# EasyEDA Pro project ProPrj_Avaota A1 八核 AIoT 开发板_2024-05-03.epro, board PCB1 (continued)
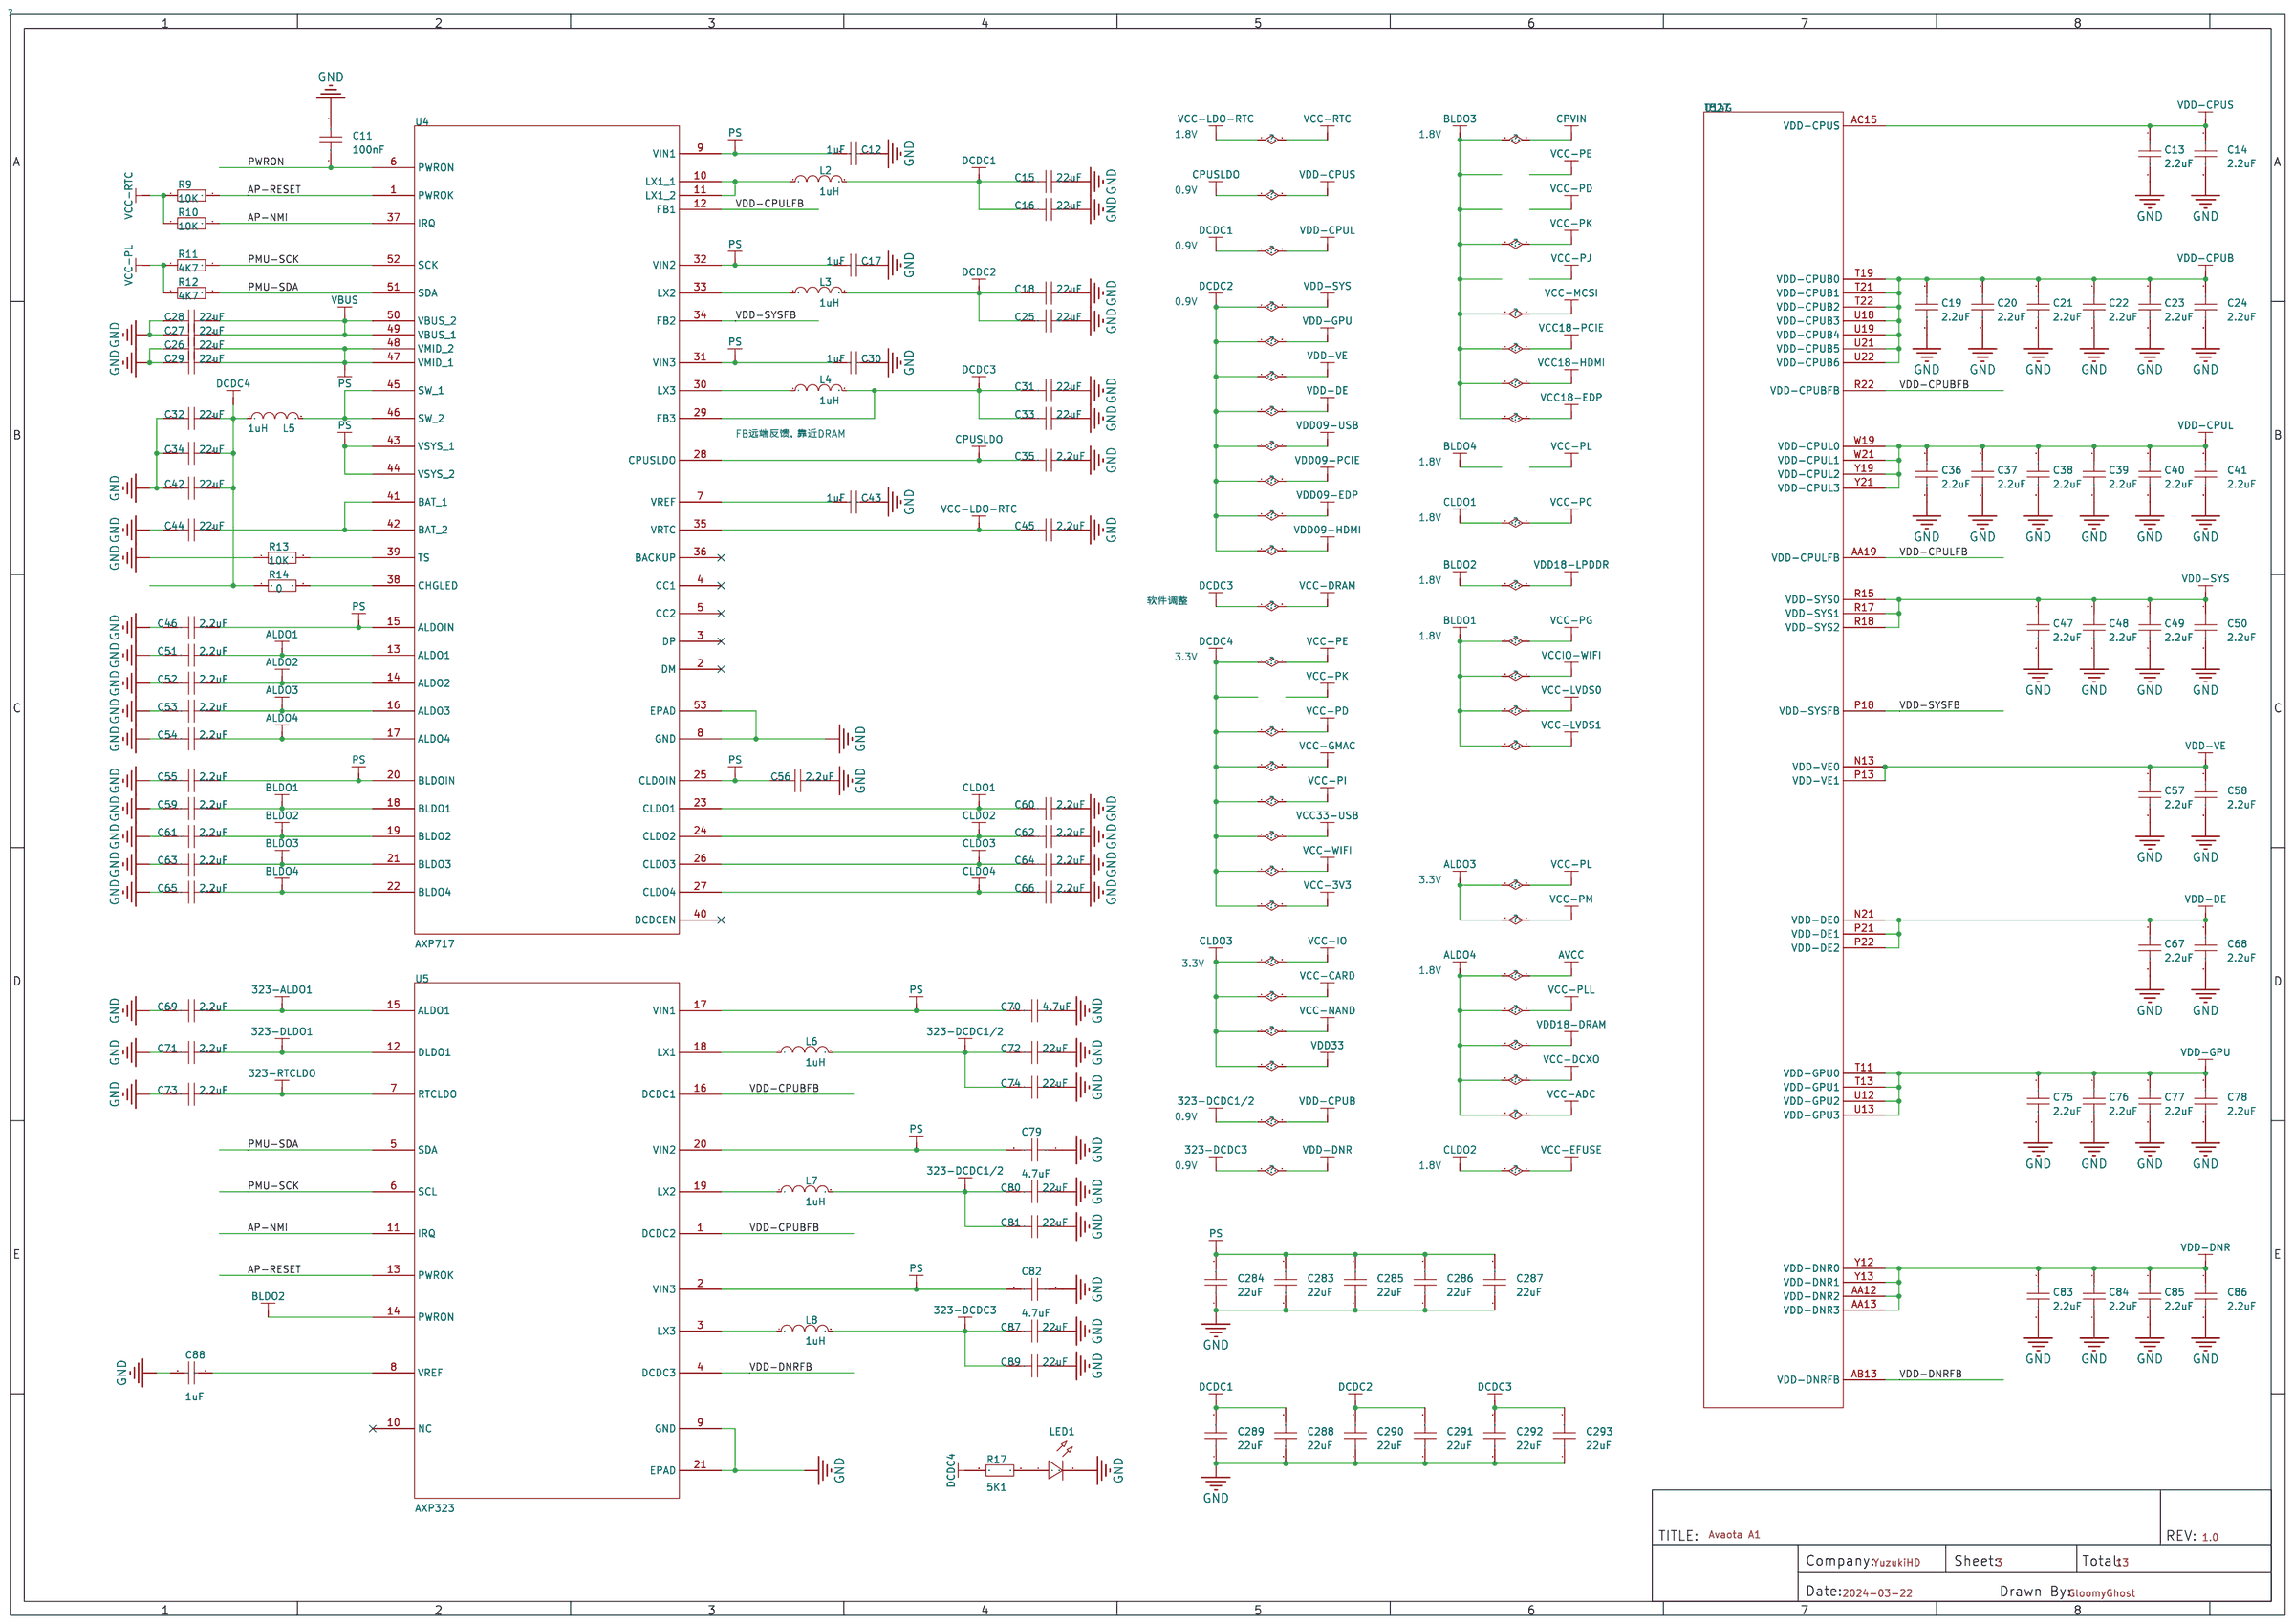
[diagram p0: POWER]
## Routing (per net, layer and track width the routed paths; a pad name or vN(x,y) marks a point on that pad's centre or on a via; arc(x,y) is an arc through that point) (continued)
  内层2 w0.102: v1(85.37,26.61) 85.37,27.15 85.5,27.28 85.5,48.18 84.81,48.87 84.81,52.3 83.92,53.19 83.92,54.13 83.41,54.64 v1(83.39,54.64)
RGMII1-RXD1: length 52.5
  Top Layer w0.076: 68.01,57.58 68.01,56.22 67.94,56.14
  Top Layer w0.102: v1(83.92,54.69) 83.72,54.89 83.72,57.2 81.41,59.51 69.89,59.51 68.01,57.64 68.01,57.58
  Top Layer w0.152: v1(85.95,26.61) 85.95,26.39 85.36,25.79 85.36,24.79
  内层2 w0.102: v1(83.92,54.69) 84.25,54.36 84.25,53.39 85.14,52.5 85.14,49.1 85.83,48.41 85.83,27.31 85.95,27.18 v1(85.95,26.61)
RGMII1-RXD2: length 60.4
  Top Layer w0.102: v1(65.95,54.65) U14.J4
  Top Layer w0.152: v1(86.51,26.61) 86.51,26.54 85.76,25.79 85.76,24.79
  内层2 w0.102: v1(65.95,54.65) 66.8,53.8 67.11,53.8 67.31,54 67.31,55.7 67.21,55.8 67.21,59.03 68.33,60.15 82.32,60.15 84.66,57.81 84.66,53.49 85.47,52.68 85.47,49.25 86.13,48.59 86.13,27.48 86.51,27.1 v1(86.51,26.61)
RGMII1-RXD3: length 59.7
  Top Layer w0.102: U14.G5 v1(66.95,54.65)
  Top Layer w0.152: 86.16,24.79 86.16,25.63 87.07,26.54 v1(87.07,26.61)
  内层2 w0.102: v1(87.07,26.61) 87.07,27.05 86.46,27.66 86.46,48.84 85.85,49.45 85.85,52.86 85.04,53.67 85.04,57.96 82.47,60.53 68.17,60.53 66.9,59.26 66.9,55.65 66.57,55.32 66.57,55.03 v1(66.95,54.65)
RGMII1-TXCK: length 60.4
  Top Layer w0.076: 66.44,56.14 66.44,56.25 66.6,56.41 66.6,58.15 66.77,58.32 66.77,58.46
  Top Layer w0.102: 87.26,24.09 87.59,24.09 87.76,24.26 v1(87.76,25.1) ; 66.77,58.46 66.77,59 69.03,61.27 83.03,61.27 86.94,57.35 86.94,53.95 v1(86.18,53.19)
  内层2 w0.102: v1(86.18,53.19) 86.23,53.14 86.23,49.58 86.82,49 86.82,27.91 87.5,27.23 87.5,25.35 v1(87.76,25.1)
RGMII1-TXCTL: length 60.4
  Top Layer w0.076: 66.44,55.64 66.69,55.89 66.69,56.23 66.78,56.32 66.78,58.04 67.03,58.29 67.03,58.52
  Top Layer w0.102: v1(86.51,54.15) 86.47,54.15 86.59,54.27 86.59,57.12 82.75,60.96 69.21,60.96 67.03,58.78 67.03,58.52 ; U13.19 87.72,23.69 88.32,24.28 v1(88.32,25.1)
  内层2 w0.102: v1(88.32,25.1) 87.83,25.58 87.83,27.38 87.15,28.07 87.15,49.25 86.61,49.78 86.61,53.42 86.51,53.52 v1(86.51,54.15)
RGMII1-TXD0: length 59.9
  Top Layer w0.076: 67.53,58.36 67.53,58.08 67.24,57.78 67.24,56.57 67.19,56.52 67.19,55.89 66.94,55.64
  Top Layer w0.102: 87.26,23.29 87.86,23.29 88.87,24.31 v1(88.87,25.1) ; 67.52,58.34 69.58,60.4 82.17,60.4 84.81,57.76 84.81,55.88 85.39,55.3 v1(85.42,55.3)
  内层2 w0.102: v1(85.42,55.3) 85.72,54.99 86.56,54.99 86.97,54.58 86.97,49.96 87.5,49.43 87.5,28.22 88.16,27.56 88.16,25.81 v1(88.87,25.1)
RGMII1-TXD1: length 61.1
  Top Layer w0.076: 66.94,56.14 67.01,56.22 67.01,57.94 67.28,58.21 67.28,58.56 67.3,58.57
  Top Layer w0.102: U13.17 88.01,22.89 89.46,24.34 v1(89.46,25.1) ; v1(86.13,55.52) 85.93,55.73 85.55,55.73 85.19,56.08 85.19,57.94 82.45,60.68 69.4,60.68 67.3,58.57
  内层2 w0.102: v1(89.46,25.1) 88.52,26.04 88.52,27.71 87.86,28.37 87.86,49.66 87.33,50.19 87.33,54.71 86.77,55.27 86.39,55.27 v1(86.13,55.52)
RGMII1-TXD2: length 66.4
  Top Layer w0.102: v1(90.02,25.1) 90.02,24.38 88.12,22.49 U13.16 ; v1(64.95,54.15) U14.L5
  内层2 w0.102: v1(64.95,54.15) 65.33,54.52 65.33,56.85 65.81,57.33 65.81,58.73 68.07,60.99 82.6,60.99 86.54,57.05 86.54,56.03 87.68,54.89 87.68,50.39 88.19,49.89 88.19,28.58 88.9,27.86 88.9,26.21 v1(90.02,25.1)
RGMII1-TXD3: length 68.1
  Top Layer w0.102: U14.L4 v1(64.95,54.65) ; 87.26,22.09 87.82,22.09 87.86,22.05 88.21,22.05 v1(89.31,23.14)
  内层2 w0.102: v1(89.31,23.14) 89.31,23.55 89.89,24.13 90.22,24.13 90.75,24.66 90.75,24.97 89.31,26.42 89.31,27.99 88.54,28.75 88.54,50.17 88.01,50.7 88.01,55.12 86.89,56.24 86.89,57.23 82.8,61.32 67.92,61.32 65.46,58.85 65.46,57.43 64.95,56.92 v1(64.95,54.65)
SAA0: length 16.5
  Top Layer w0.076: 55.43,40.14 55.18,40.39 55.18,40.75 54.87,41.07 v3(54.87,41.12)
  Top Layer w0.115: 41.41,44.85 41.71,45.16 42.34,45.16 42.47,45.03 43.33,45.03 44.27,44.09 44.42,44.09 v3(44.78,43.74)
  Inner5 w0.115: v3(54.87,41.12) 54.79,41.05 52.42,41.05 51.43,42.04 47.27,42.04 46.48,42.82 46.2,42.82 45.28,43.74 v3(44.78,43.74)
SAA1: length 17.3
  Top Layer w0.076: 55.43,40.64 55.43,40.75 55.19,40.99 55.19,41.42 v3(54.96,41.66)
  Top Layer w0.115: v3(44.4,44.48) 44.4,44.81 43.33,45.87 42.97,45.87 42.76,45.65 42.58,45.65 42.44,45.8 42.06,45.8 41.76,45.5 41.41,45.5
  Inner5 w0.076: 54.18,41.33 54.51,41.33 54.61,41.35 v3(54.96,41.66)
  Inner5 w0.115: 54.18,41.33 53.17,41.33 52.3,42.19 51.67,42.19 51.42,42.44 47.38,42.44 46.63,43.19 46.35,43.19 45.22,44.32 44.56,44.32 44.41,44.48 v3(44.4,44.48) ; v3(54.96,41.66) 54.92,41.66
SAA2: length 23.6
  Top Layer w0.102: v3(36.17,45.18) 36.16,45.18 35.83,44.85 35.81,44.85
  Top Layer w0.115: 56.43,41.64 56.43,41.68 v3(55.98,42.14)
  Inner5 w0.076: 54.05,41.93 54.13,42.01 55.09,42.01 55.29,41.81 55.6,41.81 55.93,42.14 v3(55.98,42.14)
  Inner5 w0.115: v3(36.17,45.18) 36.24,45.11 37.62,45.11 38.12,45.62 38.63,45.62 39.01,45.24 39.01,45.02 39.13,44.91 40.51,44.91 40.68,44.74 43.56,44.74 44.08,45.26 44.66,45.26 44.88,45.05 45.54,45.05 46.66,43.93 46.94,43.93 47.66,43.21 51.61,43.21 52,42.82 52.27,42.82 52.35,42.9 52.91,42.9 53.87,41.93 54.05,41.93
SAA3: length 26.5
  Top Layer w0.115: 56.43,42.14 56.43,42.19 55.98,42.65 v3(55.98,42.67) ; v3(35.33,45.17) 35.01,44.85
  内层2 w0.076: 53.87,42.82 54.07,43.02 55.7,43.02 55.98,42.75 v3(55.98,42.67)
  内层2 w0.115: v3(35.33,45.17) 35.72,44.78 36.4,44.78 36.73,45.11 36.73,46.25 36.85,46.38 37.87,46.38 37.97,46.28 37.97,45.14 38.4,44.7 38.63,44.7 39.16,44.17 40.56,44.17 40.76,44.37 41.48,44.37 42.39,43.46 42.7,43.46 43.58,42.57 43.97,42.57 44.18,42.35 52.31,42.35 52.5,42.16 53.21,42.16 53.87,42.82
SAA4: length 24.9
  Top Layer w0.102: v3(34.59,45.26) 34.59,45.24 34.21,44.85
  Top Layer w0.115: v3(55.43,42.15) 55.43,41.64
  Inner5 w0.076: 53.99,42.19 55.4,42.19 v3(55.43,42.15)
  Inner5 w0.115: 53.99,42.19 52.94,43.23 52.6,43.23 52.25,43.59 47.8,43.59 47.09,44.3 46.81,44.3 45.69,45.41 45.03,45.42 44.82,45.63 43.93,45.63 43.41,45.11 41.83,45.11 41.68,45.26 40.13,45.26 39.57,45.82 39.19,45.82 38.89,46.13 38.89,46.25 38.76,46.38 36.04,46.38 35.89,46.23 35.1,46.23 34.59,45.72 v3(34.59,45.26)
SAA5: length 29.7
  Top Layer w0.115: 34.21,45.5 34.21,45.51 34.57,45.87 34.57,46.35 v3(34.72,46.51) ; v3(55.93,41.63) 55.92,41.63 55.43,41.14
  Inner5 w0.115: v3(34.72,46.51) 35.23,47.02 35.23,47.24 37.16,49.17 38.89,49.17 39.16,49.45 39.67,49.45 39.88,49.25 40.41,49.25 40.59,49.43 41.1,49.43 41.35,49.18 41.35,49 41.68,48.67 42.67,48.67 43.47,47.87 45.39,47.87 46.97,46.29 47.6,46.29 48.02,45.87 52.09,45.87 52.47,45.49 52.7,45.49 54.05,44.14 54.05,43.56 54.3,43.31 55.88,43.31 56.34,42.85 56.34,41.96 56,41.63 v3(55.93,41.63)
SAB0: length 23.2
  Top Layer w0.115: 55.47,44.1 55.43,44.14 55.47,44.1 ; 55.47,44.1 v3(55.47,43.68) ; 41.41,49.4 41.51,49.4 v3(41.81,49.1)
  内层2 w0.076: 54,43.21 55.12,43.21 55.47,43.56 v3(55.47,43.68)
  内层2 w0.115: v3(41.81,49.1) 42.19,48.72 42.19,47.37 44.93,44.63 45.22,44.63 46.25,43.6 46.25,42.99 46.57,42.67 46.72,42.67 46.83,42.79 46.83,43.27 46.95,43.38 47.1,43.38 47.21,43.27 47.21,42.79 47.33,42.67 47.48,42.67 47.59,42.79 47.59,43.27 47.71,43.38 47.86,43.38 47.97,43.27 47.97,42.79 48.09,42.67 48.77,42.67 48.89,42.79 48.89,42.92 49,43.04 49.15,43.04 49.27,42.92 49.27,42.79 49.38,42.67 49.53,42.67 49.65,42.79 49.65,42.92 49.76,43.04 49.92,43.04 50.03,42.92 50.03,42.79 50.14,42.67 50.3,42.67 50.41,42.79 50.41,42.92 50.53,43.04 50.68,43.04 50.79,42.92 50.79,42.79 50.91,42.67 51.06,42.67 51.17,42.79 51.17,42.92 51.29,43.04 51.44,43.04 51.55,42.92 51.55,42.79 51.67,42.67 52.42,42.67 52.83,43.08 53.47,43.08 53.59,43.21 54,43.21
SAB1: length 22.6
  Top Layer w0.115: v3(43.71,48.29) 43.7,48.29 43.36,48.29 43.02,48.62 42.5,48.62 42.31,48.44 42.06,48.44 41.86,48.64 41.51,48.64 41.41,48.75 ; 55.93,44.14 56.01,44.07 v3(56.01,43.68)
  内层2 w0.115: v3(56.01,43.68) 55.59,44.09 52.52,44.09 52.07,44.55 51.14,44.55 51.03,44.44 51.03,44.1 50.91,43.98 50.76,43.98 50.64,44.1 50.64,44.44 50.53,44.55 50.38,44.55 50.26,44.44 50.26,44.1 50.15,43.98 50,43.98 49.88,44.1 49.88,44.44 49.77,44.55 49.62,44.55 49.5,44.44 49.5,44.1 49.39,43.98 49.23,43.98 49.12,44.1 49.12,44.44 49.01,44.55 46.96,44.55 45.78,45.73 45.39,45.73 44.33,46.79 44.33,46.97 44.88,47.52 44.88,47.7 44.65,47.93 44.28,47.93 44.12,47.77 44.12,47.39 44,47.28 43.84,47.28 43.71,47.41 v3(43.71,48.29)
SAB2: length 23.2
  Top Layer w0.102: v3(36.19,49.78) 35.81,49.4
  Top Layer w0.115: v3(54.43,43.71) 54.43,44.14
  内层2 w0.115: v3(54.43,43.71) 54.36,43.79 52.45,43.79 52.26,43.98 51.47,43.98 51.2,43.71 49.05,43.71 48.66,44.09 46.9,44.09 45.63,45.36 45.24,45.36 43.33,47.27 43.33,48.68 42.15,49.86 40.46,49.86 40.36,49.96 39.24,49.96 38.71,49.43 36.54,49.43 v3(36.19,49.78)
SAB3: length 25.3
  Top Layer w0.115: v3(54.96,43.68) 54.96,44.11 54.93,44.14 ; v3(37.79,48.44) 37.16,49.07 35.33,49.07 35.01,49.4
  内层2 w0.076: 53.44,43.54 53.95,43.54 54.1,43.38 54.67,43.38 v3(54.96,43.68)
  内层2 w0.115: v3(37.79,48.44) 38.4,49.05 38.78,49.05 39.22,49.48 39.65,49.48 40,49.12 40.33,49.12 40.69,49.48 41.96,49.48 42.95,48.49 42.95,47.13 45.08,45 45.38,45 46.66,43.71 48.54,43.71 48.92,43.33 51.46,43.33 51.74,43.61 52.25,43.61 52.42,43.43 53.34,43.43 53.44,43.54
SAB4: length 26
  Top Layer w0.102: 34.21,49.4 34.21,49.21 34.52,48.89 34.52,48.67 34.75,48.44 35.13,48.44 35.43,48.14 35.43,47.37 35.63,47.17 v3(35.63,47.14)
  Top Layer w0.115: v3(55.47,42.7) 55.43,42.73 55.43,43.14
  Inner5 w0.076: v3(55.47,42.7) 55.14,42.37 54.15,42.37 54.07,42.44
  Inner5 w0.115: v3(35.63,47.14) 36.01,46.76 39.88,46.76 40.59,46.05 40.59,45.77 40.75,45.61 42.74,45.61 43.13,46 44.97,46 45.18,45.78 45.84,45.78 46.96,44.67 47.24,44.67 47.94,43.97 52.3,43.97 52.73,43.54 53.01,43.54 54.07,42.47 54.07,42.44
SAB5: length 27
  Top Layer w0.102: v3(34.34,46.96) 34.49,47.12 34.49,48.39 34.21,48.67 34.21,48.75
  Top Layer w0.115: 54.43,42.14 v3(54.43,41.66)
  Inner5 w0.115: v3(54.43,41.66) 53.17,41.66 52.35,42.48 51.9,42.48 51.56,42.82 47.52,42.82 46.79,43.56 46.5,43.56 45.39,44.68 44.72,44.68 44.52,44.88 44.25,44.88 43.69,44.32 40.66,44.32 40.5,44.16 39.17,44.16 38.63,44.7 38.28,44.7 37.89,44.32 36.55,44.32 36.17,44.7 35,44.7 34.85,44.86 34.41,44.86 34.19,45.08 34.19,46.81 v3(34.34,46.96)
SCKE0-A: length 22
  Top Layer w0.076: 52.95,40.58 53.26,40.89 53.54,40.89 53.79,41.14 53.93,41.14
  Top Layer w0.115: v3(45.75,42.76) 46.17,42.76 48.35,40.58 52.95,40.58 ; 39.81,45.5 39.81,45.73 39.69,45.85 38.66,45.85 v3(38.5,46)
  内层2 w0.115: v3(45.75,42.76) 45.75,43.28 44.92,44.11 44.25,44.11 43.38,44.98 42.72,44.98 42.16,45.54 42.16,46.66 41.43,47.4 39.27,47.4 38.5,46.63 v3(38.5,46)
SCKE0-B: length 21.4
  Top Layer w0.076: 52.49,43.14 52.25,42.9 51.79,42.9 51.66,43.03
  Top Layer w0.097: 53.43,43.14 52.49,43.14
  Top Layer w0.115: v3(45.11,47.12) 45.03,47.12 44.22,47.93 44.22,48.15 44.38,48.31 44.57,48.31 45.87,47.02 46.45,47.02 46.89,46.58 46.89,45.29 49.15,43.03 51.66,43.03 ; 39.81,48.75 39.7,48.75 v3(39.39,48.44)
  Inner5 w0.115: v3(45.11,47.12) 43.18,47.12 43.03,47.27 41.04,47.27 40.41,47.9 39.19,47.9 39.06,48.03 39.06,48.27 39.23,48.44 v3(39.39,48.44)
SCKE1-A: length 22.4
  Top Layer w0.076: 54.43,41.14 54.18,40.89 53.83,40.89 53.68,40.74 53.68,40.5 53.57,40.39 53.33,40.39 52.93,39.99
  Top Layer w0.102: v3(38.5,45.21) 38.78,45.49 38.98,45.49 38.99,45.5 39.01,45.5
  Top Layer w0.115: 52.93,39.99 52.86,39.99 52.85,39.98 48.11,39.98 46,42.09 45.38,42.09 45.02,42.44 45.02,42.89 44.71,43.19 44.31,43.19 v3(44.09,42.98)
  内层2 w0.115: v3(38.5,45.21) 38.76,45.21 39.04,44.93 39.6,44.93 39.77,45.11 39.77,46.13 40.03,46.38 40.41,46.38 40.61,46.18 40.61,45.29 40.92,44.98 41.43,44.98 42.16,44.25 43,44.25 43.23,44.02 43.23,43.46 43.7,42.99 44.09,42.99 v3(44.09,42.98)
SCKE1-B: length 21.8
  Top Layer w0.076: 53.93,43.14 53.68,42.89 53.22,42.89 53.14,42.97 52.57,42.97 52.32,42.72 51.55,42.72
  Top Layer w0.115: 39.01,48.75 38.97,48.75 v3(38.63,48.41) ; 51.55,42.72 51.52,42.7 49.1,42.7 46.62,45.18 46.62,46.4 46.33,46.68 45.87,46.68 v3(45.7,46.52)
  Inner5 w0.115: v3(45.7,46.52) 45.55,46.52 45.34,46.74 43.04,46.74 42.88,46.89 40.87,46.89 40.23,47.52 38.8,47.52 38.69,47.64 38.69,47.92 38.58,48.03 38.35,48.03 38.23,47.92 38.23,47.64 38.12,47.52 37.92,47.52 37.82,47.62 37.82,47.93 38.3,48.41 v3(38.63,48.41)
SCKN-A: length 21.6
  Top Layer w0.076: 35.81,45.5 36.02,45.5 36.1,45.58 36.1,46.41 36.08,46.43 36.08,46.45 ; 52.35,41.43 52.47,41.55 52.58,41.55 52.7,41.43 52.81,41.43 52.97,41.59 53.39,41.59 53.43,41.64
  Top Layer w0.127: 52.35,41.43 48.64,41.43 45.39,44.68 45.39,44.98 43.41,46.96 36.3,46.96 36.08,46.74 36.08,46.45
SCKN-B: length 21.2
  Top Layer w0.076: 53.43,42.14 53.33,42.14 53.2,42.01 52.48,42.01 52.35,42.14 51.97,42.14 51.69,41.86 50.74,41.86 50.71,41.88 50.54,41.88 ; 36.77,47.38 36.76,47.38 36.74,47.4 36.68,47.4 36.65,47.43 36.59,47.43 36.12,47.89 36.12,48.44 35.81,48.75
  Top Layer w0.127: 50.54,41.88 48.86,41.88 45.9,44.85 45.9,45.11 43.63,47.38 36.77,47.38
SCKP-A: length 21.6
  Top Layer w0.076: 36.61,45.5 36.31,45.8 36.31,46.41 36.33,46.43 36.33,46.45 ; 52.35,41.17 52.85,41.17 53.07,41.39 53.68,41.39 53.93,41.64
  Top Layer w0.127: 52.35,41.17 48.54,41.17 45.13,44.58 45.13,44.88 43.31,46.71 36.41,46.71 36.33,46.63 36.33,46.45
SCKP-B: length 21.9
  Top Layer w0.076: 50.54,42.14 50.75,42.14 50.82,42.06 51.04,42.06 51.11,42.14 51.11,42.21 51.19,42.29 51.34,42.29 51.42,42.21 51.42,42.14 51.5,42.06 51.6,42.06 51.87,42.33 52.39,42.33 52.39,42.33 52.41,42.33 52.53,42.2 53.07,42.2 53.26,42.39 53.68,42.39 53.93,42.64 ; 36.77,47.63 36.67,47.63 36.3,48 36.3,48.67 36.37,48.75 36.61,48.75
  Top Layer w0.127: 36.77,47.63 43.73,47.63 46.15,45.21 46.15,44.96 48.97,42.14 50.54,42.14
SCS0-A: length 21
  Top Layer w0.076: 53.43,40.64 53.29,40.64 52.93,40.28 52.78,40.28
  Top Layer w0.115: v3(45.24,43.23) 45.39,43.08 45.39,42.6 45.59,42.39 46.12,42.39 48.23,40.28 52.78,40.28 ; 39.81,44.85 39.76,44.85 39.39,45.21 v3(39.39,45.29)
  内层2 w0.115: v3(45.24,43.23) 45.11,43.36 43.85,43.36 43.6,43.61 43.6,44.17 43.15,44.61 42.43,44.61 41.37,45.67 41.37,46.9 41.26,47.02 39.39,47.02 39.01,46.63 39.01,45.67 v3(39.39,45.29)
SCS0-B: length 23.7
  Top Layer w0.115: v3(39.39,49.1) 39.69,49.4 39.81,49.4 ; 54.93,42.14 54.93,42.17 v3(54.41,42.7)
  Inner5 w0.115: v3(39.39,49.1) 39.11,48.82 37.62,48.82 37.41,48.62 37.41,47.35 37.62,47.14 40.03,47.14 40.7,46.47 42.79,46.47 42.88,46.37 45.12,46.37 45.34,46.15 46,46.15 47.11,45.03 47.4,45.03 48.12,44.31 52.36,44.31 52.78,43.89 53.03,43.89 54.23,42.7 v3(54.41,42.7)
SCS1-A: length 20.7
  Top Layer w0.076: 52.86,38.63 53,38.78 53,39.16 53.68,39.84 53.68,40.25 53.93,40.49 53.93,40.64
  Top Layer w0.115: 52.86,38.63 52.47,38.63 52.27,38.84 52.27,39.4 51.99,39.67 47.9,39.67 45.84,41.73 45.21,41.73 44.65,42.29 44.65,42.72 v3(44.63,42.75) ; 40.61,44.85 40.88,44.85 40.99,44.73 40.99,43.94 v3(41.02,43.92)
  Inner5 w0.115: v3(44.63,42.75) 44.74,42.75 44.85,42.86 44.85,43.24 44.74,43.36 43.9,43.36 43.79,43.47 43.79,43.85 43.67,43.97 43.44,43.97 43.33,43.85 43.33,43.36 43.22,43.24 42.94,43.24 42.72,43.46 42.56,43.46 42.44,43.57 42.44,43.84 42.36,43.92 42.11,43.92 42,43.8 42,43.7 41.88,43.59 41.66,43.59 41.54,43.7 41.54,43.8 41.43,43.92 v3(41.02,43.92)
SCS1-B: length 22.5
  Top Layer w0.102: 54.93,43.14 54.93,42.7 v3(54.94,42.7)
  Top Layer w0.115: v3(40.92,49.07) 40.92,49.09 40.61,49.4
  Inner5 w0.115: v3(54.94,42.7) 55.02,42.7 55.12,42.79 55.12,42.95 55.01,43.05 54.25,43.05 53.72,43.59 53.72,43.93 53.61,44.04 53.39,44.04 53.29,44.14 53.29,44.27 53.16,44.4 52.73,44.4 52.53,44.6 52.53,44.97 52.4,45.09 52.24,45.09 52.12,44.97 52.12,44.77 52,44.65 51.85,44.65 51.73,44.77 51.73,44.94 51.62,45.06 51.39,45.06 51.28,44.94 51.28,44.77 51.16,44.65 50.93,44.65 50.82,44.77 50.82,44.94 50.7,45.06 50.48,45.06 50.36,44.94 50.36,44.77 50.25,44.65 50.02,44.65 49.91,44.77 49.91,44.98 49.79,45.09 49.56,45.09 49.45,44.98 49.45,44.77 49.33,44.65 49.1,44.65 48.99,44.77 48.99,44.94 48.88,45.06 48.65,45.06 48.53,44.94 48.53,44.77 48.42,44.65 48.3,44.65 47.64,45.32 47.64,45.77 47.48,45.92 46.81,45.92 45.24,47.5 43.32,47.5 43.06,47.75 41.07,47.75 40.61,48.21 40.61,48.92 40.76,49.07 v3(40.92,49.07)
SDC0-CLK: length 39.7
  Top Layer w0.102: v1(94.77,48.82) 95.45,48.82 95.91,48.36 96.11,48.36 96.22,48.46 96.22,48.67 95.66,49.23 93.62,49.23 93.32,49.53 89.69,49.53 87.22,47.07 73.14,47.07 R42.2
  Bottom Layer w0.102: v1(94.77,48.82) 94.77,50.3 D19.2 95.58,52.03 95.58,55.58 96.37,56.36 96.37,57.33 97.84,58.8 97.84,59.21 98.54,59.91 SIM1.5
SDC0-CMD: length 39.6
  Top Layer w0.076: 71.87,47.38 70.69,47.38 70.37,47.06 69.15,47.06 69.09,47.12 68.95,47.12
  Top Layer w0.102: v1(96.6,48.77) 95.83,49.53 93.85,49.53 93.55,49.84 89.59,49.84 87.12,47.37 71.88,47.37 71.87,47.38
  Bottom Layer w0.102: v1(96.6,48.77) 96.6,50.3 D21.2 96.65,51.27 96.65,54.99 97.36,55.7 97.36,56.49 98.58,57.71 SIM1.3
SDC0-D0: length 41.8
  Top Layer w0.076: 72.54,46.63 72.34,46.63 72.14,46.84 71.7,46.84 71.51,47.02 70.84,47.02 70.53,46.71 69.51,46.71 69.44,46.64
  Top Layer w0.102: 72.54,46.63 73.33,46.63 73.46,46.76 87.35,46.76 89.81,49.23 93.14,49.23 93.55,48.82 v1(93.83,48.82)
  Bottom Layer w0.102: v1(93.83,48.82) 93.83,50.29 D18.1 95.1,52.51 95.1,55.78 95.88,56.57 95.88,57.51 97.18,58.8 97.18,60.71 98.59,62.11 SIM1.7
SDC0-D1: length 42.9
  Top Layer w0.076: 68.94,46.64 69.09,46.64 69.09,46.64 69.35,46.38 69.58,46.38 69.73,46.54 70.63,46.54 70.93,46.83 71.33,46.83 71.53,46.63 71.98,46.63 72.21,46.41 72.52,46.41
  Top Layer w0.102: v1(92.86,48.82) 92.76,48.92 89.97,48.92 87.53,46.48 73.61,46.48 73.53,46.41 72.52,46.41
  Bottom Layer w0.102: v1(92.86,48.82) 92.86,50.3 D17.2 94.61,52.97 94.61,55.96 95.48,56.82 95.48,57.71 96.7,58.93 96.7,60.93 97.76,62 97.76,62.46 98.52,63.21 SIM1.8
SDC0-D2: length 38.9
  Top Layer w0.076: 69.44,47.64 69.76,47.64 70.05,47.93 70.51,47.93 70.61,47.83 71.53,47.83 71.6,47.9
  Top Layer w0.102: v1(98.48,48.82) 98.09,49.2 97.66,49.2 97.33,49.53 96.82,49.53 96.24,50.11 94.31,50.11 93.95,50.47 89.26,50.47 86.69,47.9 71.6,47.9
  Bottom Layer w0.102: SIM1.1 98.31,55.51 97.49,54.69 97.49,51.24 D23.2 98.48,50.25 v1(98.48,48.82)
SDC0-D3: length 39.4
  Top Layer w0.076: 71.65,47.65 71.58,47.57 70.59,47.57 70.42,47.74 70.1,47.74 69.75,47.39 69.31,47.39 69.06,47.64 68.94,47.64
  Top Layer w0.102: 71.65,47.65 86.89,47.65 89.38,50.14 93.73,50.14 94.06,49.81 96.01,49.81 96.62,49.2 97.13,49.2 v1(97.51,48.82)
  Bottom Layer w0.102: v1(97.51,48.82) 97.51,50.33 D22.1 97.08,54.86 97.74,55.52 97.74,55.83 98.45,56.54 98.74,56.54 SIM1.2
SDC0-DET: length 29
  Top Layer w0.102: U14.D20 v1(67.94,47.18) ; v2(91.97,48.51) 91.87,48.62 90.14,48.62 87.71,46.18 73.86,46.18 v1(73.81,46.13)
  Bottom Layer w0.102: v1(73.81,46.13) 72.01,46.13 71.17,46.96 70.79,46.96 70.69,46.86 68.26,46.86 v1(67.94,47.18)
  Bottom Layer w0.127: 90.7,50.33 90.7,48.97 91.01,48.67 91.82,48.67 v2(91.97,48.51)
SDC1-CLK: length 48
  Top Layer w0.102: R43.2 62.99,60.48 61.82,61.65 55.75,61.65 54.05,59.94 34.09,59.94 27,52.86 22.45,52.86 21.56,53.75 21.56,54.76
SDC1-CMD: length 53.2
  Top Layer w0.076: 63.27,58.5 63.27,58.34 62.71,57.78 62.71,56.06 62.44,55.79 62.44,55.64
  Top Layer w0.102: v1(21.01,53.8) 20.66,54.14 20.66,54.76 ; v1(22.53,53.54) 22.94,53.14 26.75,53.14 33.86,60.25 53.9,60.25 55.6,61.95 61.93,61.95 63.35,60.53 63.35,58.57 63.27,58.5
  Bottom Layer w0.102: v1(21.01,53.8) 22.28,53.8 v1(22.53,53.54)
SDC1-D0: length 52.3
  Top Layer w0.076: 62.94,55.14 62.69,55.39 62.69,55.78 62.87,55.96 62.87,57.69 63.6,58.42 63.6,58.44
  Top Layer w0.102: 22.46,54.76 22.46,54.42 23.42,53.47 26.54,53.47 33.66,60.58 53.75,60.58 55.42,62.26 62.05,62.26 63.68,60.63 63.68,58.52 63.6,58.44
SDC1-D1: length 51.3
  Top Layer w0.076: 63.96,58.55 63.96,58.5 63.04,57.57 63.04,55.74 62.94,55.64
  Top Layer w0.102: 23.36,54.76 23.36,54.12 23.66,53.82 26.42,53.82 33.5,60.91 53.59,60.91 55.25,62.56 62.2,62.56 63.96,60.81 63.96,58.55
SDC1-D2: length 54.3
  Top Layer w0.076: 61.94,55.14 61.69,55.39 61.69,55.77 61.85,55.93 61.85,56.35 61.7,56.5 61.68,56.82 61.63,57.2 61.66,57.54 61.84,57.86 61.99,58.2
  Top Layer w0.102: 18.86,54.76 18.86,54.44 21.03,52.27 27.48,52.27 34.54,59.33 54.41,59.33 56.13,61.06 61.59,61.06 62.36,60.3 62.36,58.57 61.98,58.19
SDC1-D3: length 53.3
  Top Layer w0.076: 61.94,55.64 62.03,55.74 62.03,56.5 61.87,56.66 61.87,57.02 61.87,57.31 61.99,57.65 62.22,58.05
  Top Layer w0.102: 19.76,54.76 19.76,54.28 21.49,52.55 27.2,52.55 34.29,59.64 54.23,59.64 55.96,61.37 61.72,61.37 62.66,60.43 62.66,58.5 62.23,58.06
SDC2-CLK: length 25.7
  Top Layer w0.102: R41.1 58.82,37.54 58.37,37.54 58.27,37.44 40.97,37.44 40.26,36.73 39.7,36.73 v1(39.52,36.55) ; U8.M6 37.17,33.44 37.38,33.64 v1(37.68,33.64)
  Bottom Layer w0.102: v1(39.52,36.55) 39.73,36.75 39.85,36.75 39.97,36.64 39.97,36.49 38.05,34.57 37.59,34.57 37.31,34.29 37.31,34.01 v1(37.68,33.64)
SDC2-CMD: length 27.8
  Top Layer w0.076: 60.49,37.99 60.57,38.31 60.54,39.12 60.54,39.53 60.53,39.84 60.46,40.02 60.41,40.13
  Top Layer w0.102: U8.M5 37.17,33.89 37.42,34.14 v1(37.68,34.14) ; v1(41.55,36.5) 41.91,36.86 58.6,36.86 58.7,36.96 59.77,36.96 60.17,37.36 60.17,37.67 60.5,37.99
  Bottom Layer w0.102: v1(37.68,34.14) 37.87,34.14 38.18,33.83 38.48,33.83 38.86,34.22 38.86,34.42 40.51,36.07 40.74,36.07 41.15,36.47 41.15,36.5 v1(41.55,36.5)
SDC2-D0: length 23
  Top Layer w0.076: 60.94,40.6 60.99,40.48 61.02,40.44 61.02,39.96 61.09,39.77 61.11,39.22 61.17,38.34 61.18,38.03 61.12,37.66 61.11,37.43
  Top Layer w0.102: 61.12,37.42 61.01,37.29 61.01,36.88 60.2,36.07 59.41,36.07 59.08,35.74 44.93,35.74 44.08,34.89 U8.A3
SDC2-D1: length 24.1
  Top Layer w0.076: U14.U32 61.44,40.54 61.69,40.29 61.68,40.01 61.5,39.78 61.5,39.17 61.6,37.39
  Top Layer w0.102: U8.A4 44.65,34.39 45.31,35.05 59.54,35.05 59.84,35.36 60.43,35.36 61.61,36.54 61.61,37.38
SDC2-D2: length 25
  Top Layer w0.076: 62.13,37.54 62.13,37.67 61.95,38.25 61.92,39.64 62.02,39.81 62.02,40.41 62.02,40.57 61.94,40.65
  Top Layer w0.102: 62.13,37.54 62.12,37.53 62.12,36.03 60.81,34.72 60.17,34.72 59.87,34.42 45.85,34.42 45.31,33.88 42.68,33.88 U8.A5
SDC2-D3: length 24.6
  Top Layer w0.076: 60.69,39.86 60.69,40.3 60.44,40.55 60.44,40.65 ; 60.67,37.72 60.78,38.31 60.76,38.66 60.73,39.67 60.69,39.86
  Top Layer w0.102: U8.B2 42.42,35.64 42.85,35.64 43.1,35.38 43.61,35.38 43.97,35.74 43.97,35.87 43.84,35.99 43.33,35.99 43.19,36.14 43.19,36.28 43.33,36.42 58.64,36.42 58.87,36.65 59.89,36.65 60.45,37.21 60.45,37.51 60.67,37.72
SDC2-D4: length 23.8
  Top Layer w0.076: 60.88,37.77 60.99,38.24 60.96,38.58 60.93,39.74 60.86,39.93 60.86,40.38 60.69,40.54 60.69,40.9 60.44,41.15
  Top Layer w0.102: U8.B3 42.41,35.13 43.79,35.13 44.75,36.09 58.85,36.09 59.13,36.37 60.05,36.37 60.73,37.06 60.73,37.43 60.88,37.58 60.88,37.77
SDC2-D5: length 24.7
  Top Layer w0.076: 60.94,41.15 61.19,40.9 61.19,40.04 61.26,39.86 61.26,39.86 61.36,38.48 61.36,38.24 61.34,37.46
  Top Layer w0.102: U8.B4 42.43,34.65 44.37,34.65 45.11,35.38 59.26,35.38 59.61,35.74 60.32,35.74 61.34,36.75 61.34,37.47
SDC2-D6: length 25.8
  Top Layer w0.076: 61.87,37.48 61.81,37.56 61.75,38.19 61.69,39.17 61.69,39.73 61.74,39.82 61.84,39.95 61.85,40.36 61.7,40.52 61.7,40.9 61.44,41.15
  Top Layer w0.102: 61.88,37.47 61.88,36.3 60.63,35.05 60,35.05 59.66,34.72 45.57,34.72 44.98,34.14 42.42,34.14 U8.B5
SDC2-D7: length 26.7
  Top Layer w0.076: 61.94,41.15 62.19,40.91 62.19,39.71 62.12,39.56 62.15,38.31 62.35,37.56
  Top Layer w0.102: U8.B6 42.41,33.63 45.59,33.63 46.05,34.09 60.05,34.09 60.4,34.44 60.99,34.44 62.43,35.89 62.43,37.49 62.36,37.57
SDC2-DS: length 27.9
  Top Layer w0.127: U14.W28 v1(60.81,42.64) ; U8.H5 39.55,34.27 v1(39.55,34.34)
  内层4 w0.127: v1(60.81,42.64) 60.81,38.86 56.29,34.34 v1(39.55,34.34)
SDC2-RST: length 27.4
  Top Layer w0.076: 59.94,41.15 60.19,40.9 60.19,39.9 60.36,39.73 60.36,38.31
  Top Layer w0.102: v1(40.59,36.5) 41.22,37.14 58.42,37.14 58.52,37.24 59.61,37.24 59.89,37.52 59.89,37.72 60.33,38.19 60.36,38.32 ; U8.K5 38.17,34.01 v1(38.41,34.24)
  Bottom Layer w0.102: v1(40.59,36.5) 40.44,36.5 38.41,34.47 v1(38.41,34.24)
SDQ0: length 21.9
  Top Layer w0.115: 57.43,42.64 57.37,42.7 v3(57.02,42.7) ; 39.81,42.9 39.67,42.9 39.37,43.21 v3(39.37,43.23)
  内层2 w0.115: v3(39.37,43.23) 39.42,43.23 39.7,42.95 41.04,42.95 41.63,42.37 41.96,42.37 42.19,42.14 42.19,41.76 42.86,41.08 51.12,41.08 51.53,40.68 53.83,40.68 54.09,40.43 56.2,40.43 56.56,40.79 56.56,42.25 v3(57.02,42.7)
SDQ1: length 21.4
  Top Layer w0.076: 57.43,43.14 57.12,43.14 v3(57.05,43.21)
  Top Layer w0.115: v3(40.22,43.81) 40.2,43.81 40.18,43.79 40.05,43.79 39.81,43.55
  内层2 w0.076: 55.88,40.69 55.8,40.61 54.33,40.61 54.25,40.69
  内层2 w0.115: v3(40.22,43.81) 40.7,43.33 41.17,43.33 41.77,42.74 42.18,42.74 42.23,42.68 42.89,42.68 43.41,42.16 43.41,41.73 43.63,41.5 51.18,41.5 51.67,41.01 53.94,41.01 54.25,40.69 ; v3(57.05,43.21) 57.03,43.21 56.34,42.52 56.34,40.89 56.13,40.69 55.88,40.69
SDQ2: length 22.4
  Top Layer w0.115: 41.41,42.9 41.72,42.58 42.81,42.58 43.05,42.34 43.18,42.34 43.41,42.12 43.41,41.83 43.66,41.58 43.81,41.58 45.01,40.39 45.59,40.39 45.77,40.56 45.77,40.79 45.54,41.02 44.83,41.02 43.89,41.96 v3(43.81,41.96) ; v3(55.98,41.12) 56.43,40.67 56.43,40.64
  内层2 w0.076: 54.53,40.84 54.58,40.79 55.65,40.79 v3(55.98,41.12)
  内层2 w0.115: 54.53,40.84 54,41.38 53.69,41.38 53.57,41.49 53.57,41.69 53.46,41.81 53.23,41.81 53.12,41.69 53.12,41.49 53,41.38 51.94,41.38 51.38,41.94 43.84,41.94 v3(43.81,41.96)
